# EasyEDA Pro project YanQi_Project_V2.0.eprj, board PayloadBoard (continued)
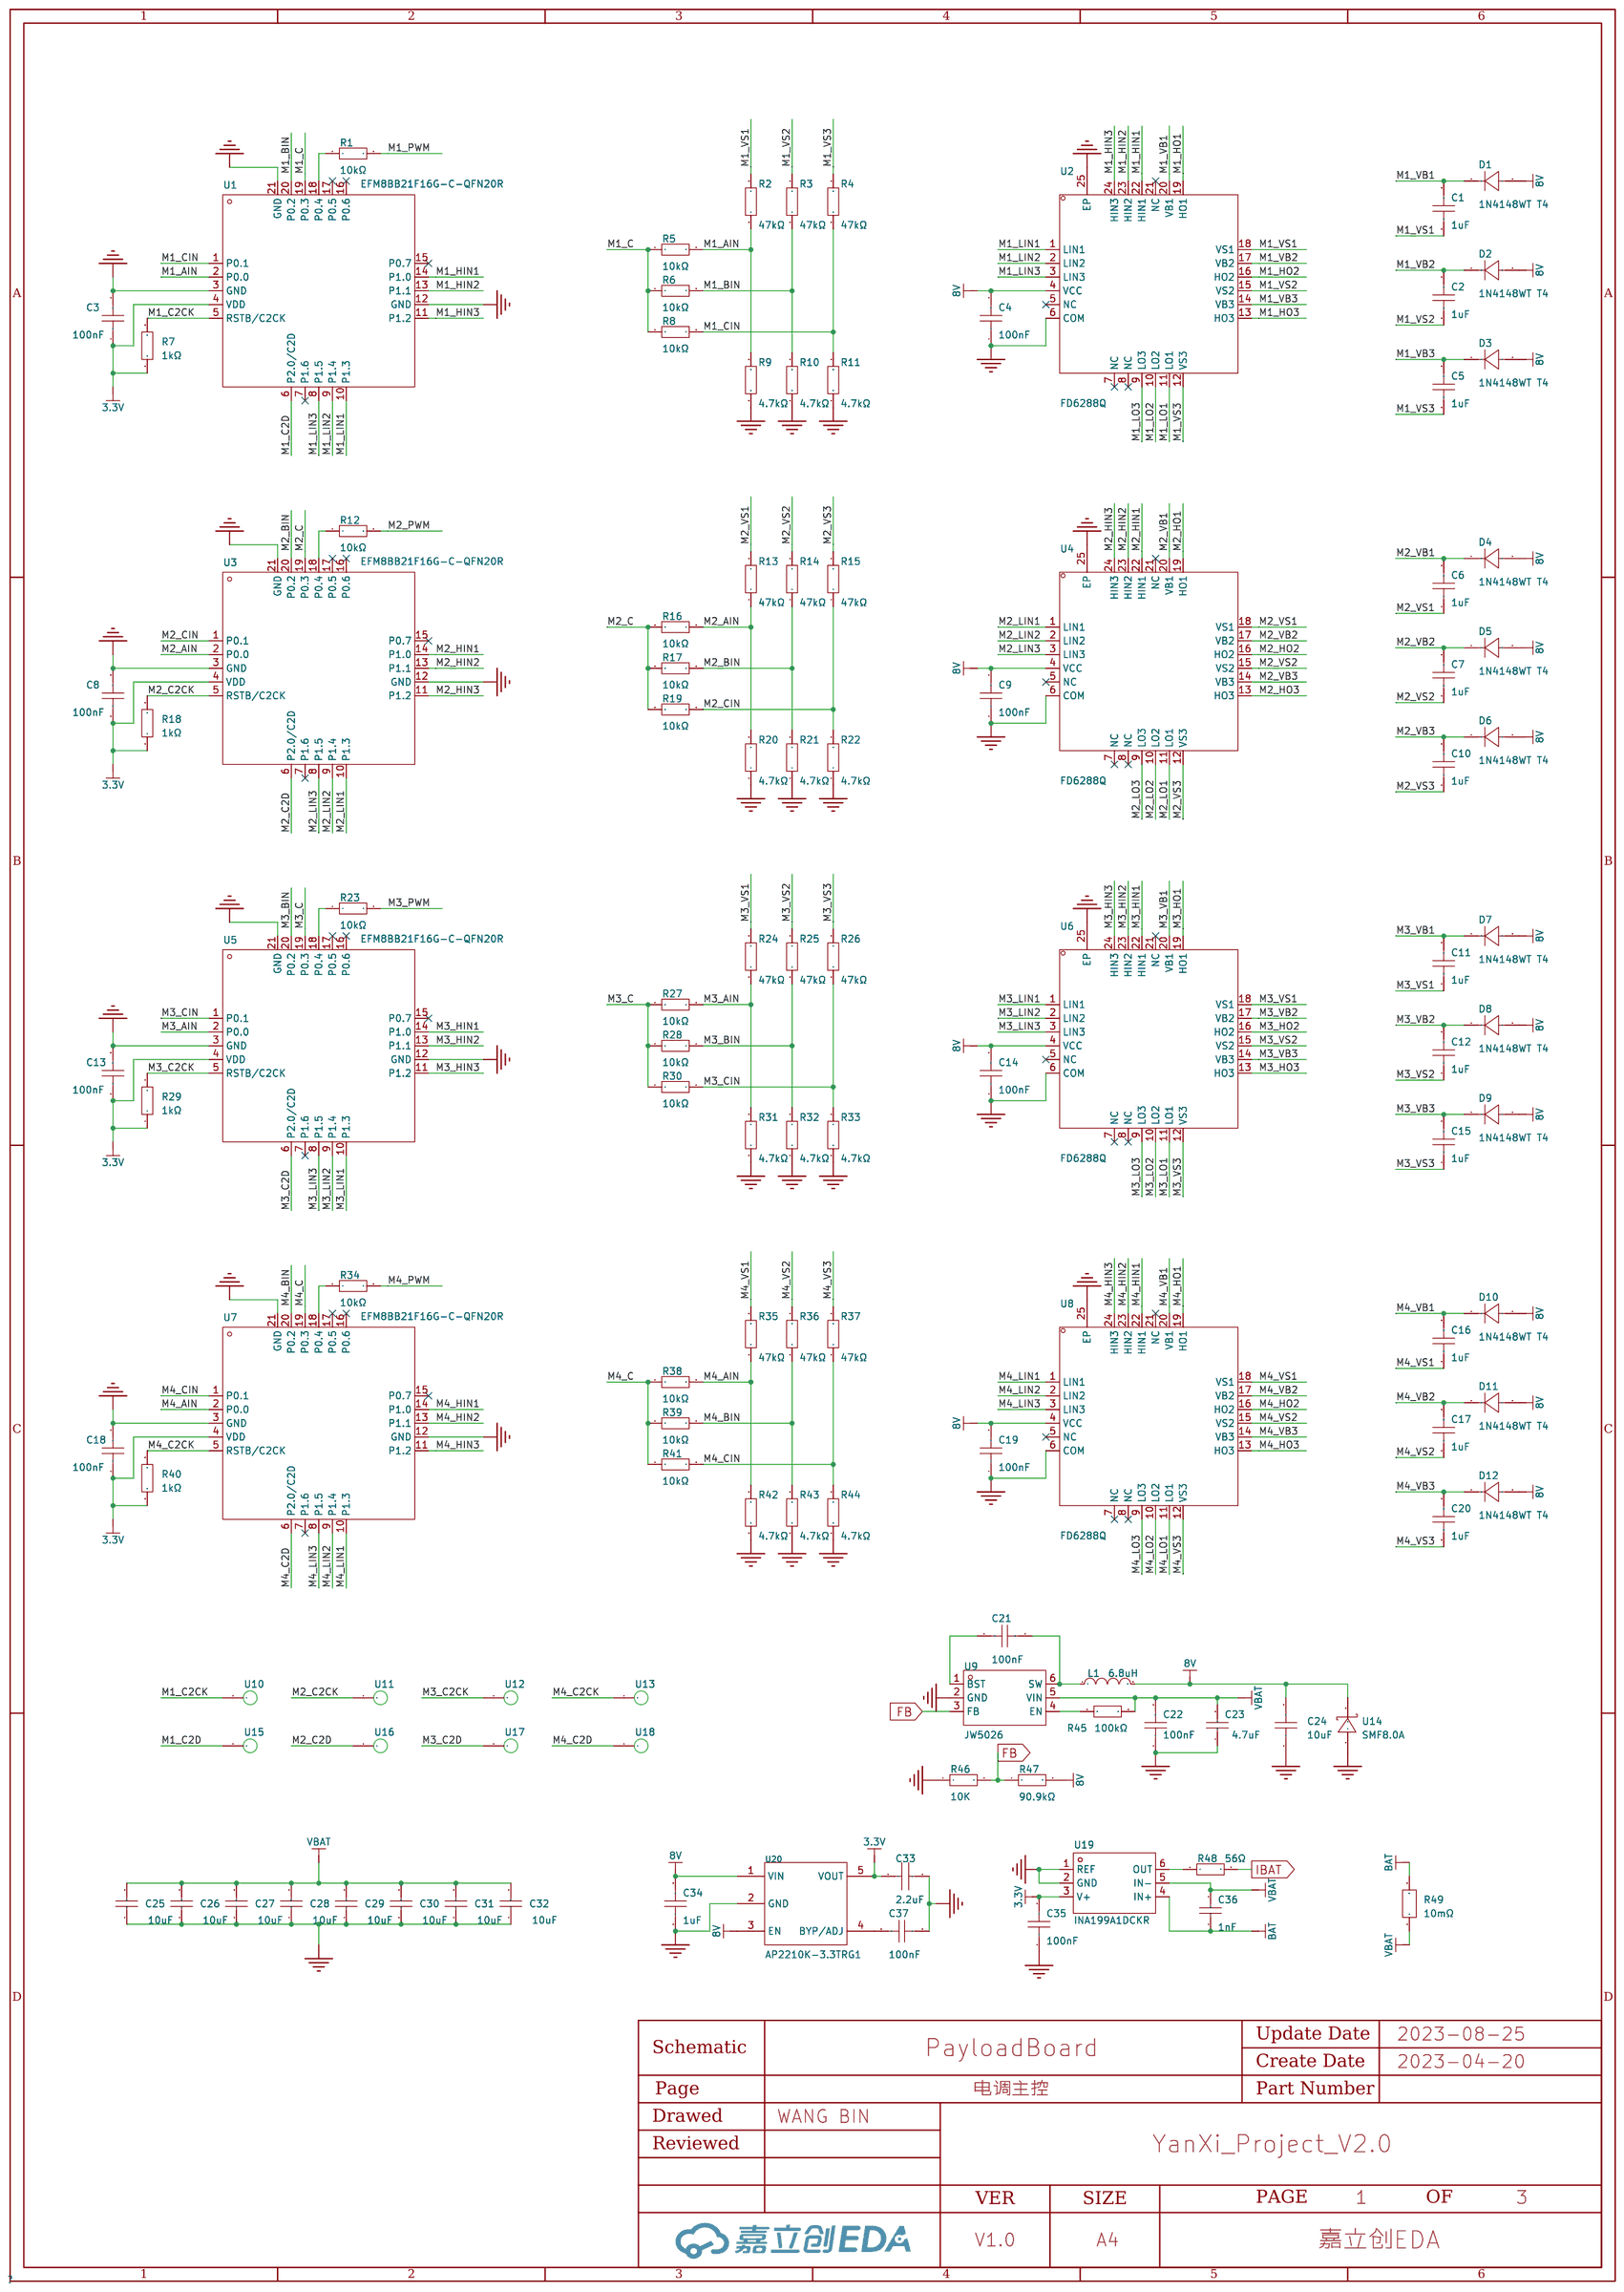
[diagram p0: 电调主控]
## Routing (per net, layer and track width the routed paths; a pad name or vN(x,y) marks a point on that pad's centre or on a via; arc(x,y) is an arc through that point) (continued)
  Inner2 w0.254: 15.25,46.89 15.25,47.7 15.75,48.2 15.75,48.95 15.25,49.45 15.25,52.5 v1(17.4,54.65) ; 15.25,46.89 15.25,42.85 14.05,41.65 14.05,37.9 13.7,37.55 v1(13.5,37.55) ; 15.25,46.89 15.21,46.85 v1(14.7,46.85) ; v1(77.13,83.36) 77.13,83.01 74.57,80.45 72.9,80.45 72.15,79.7 v1(70.7,79.7) 70.6,79.8 v1(68.8,79.8) v1(68.3,79.8) ; v1(70.65,73.4) 71.75,73.4 72.3,72.85 72.3,70.5 71.75,69.95 71.75,41.7 v1(72.15,41.3) 72.6,41.3 73.1,41.8 v1(73.8,41.8)
  Bottom Layer w0.254: v1(74.4,71.35) 72.66,71.35 72.25,71.76 72.25,72.95 71.8,73.4 v1(70.65,73.4) 70.65,73.36 ; v1(11.43,83.35) 11.15,83.35 11,83.2 U6.4 ; v1(76.07,34.65) 76.35,34.65 76.5,34.8 U8.4 ; v1(68.8,79.8) 70.6,79.8 v1(70.7,79.7) ; v1(10.37,34.64) 10.5,34.76 U4.4 ; v1(77.13,83.36) 77,83.24 U2.4
  Bottom Layer w0.6: 67.5,80.76 67.5,80.35 68.05,79.8 v1(68.3,79.8) v1(68.8,79.8) ; 67.5,80.76 67.5,81.2 68,81.7 U20.1 ; 67.5,80.76 65.38,80.76 64.73,81.4 64.73,81.93 65.47,82.67 65.47,83
GND:
  vias: v1(0.5,72.2) v1(0.5,45.8) v1(0.95,72.2) v1(0.95,71.75) v1(0.95,46.25) v1(0.95,45.8) v1(1.05,44.43) v1(1.05,43.78) v1(1.05,43.13) v1(1.4,72.2) v1(1.4,71.75) v1(1.4,46.25) v1(1.4,45.8) v1(1.83,81.96) v1(1.85,71.75) v1(1.85,46.25) v1(1.85,45.8) v1(2.01,35.63) v1(2.28,82.41) v1(2.28,81.96) v1(2.28,78.04) v1(2.28,39.96) v1(2.46,35.63) v1(2.46,35.18) v1(4.05,74.88) v1(4.05,74.23) v1(4.05,73.58) v1(5.25,44.43) v1(5.25,43.78) v1(5.25,43.13) v1(6.02,35.61) v1(6.02,35.16) v1(6.21,82.42) v1(6.21,81.97) v1(6.47,35.61) v1(6.66,81.97) v1(8.25,74.88) v1(8.25,74.23) v1(8.25,73.58) v1(9.45,44.43) v1(9.45,43.78) v1(9.45,43.13) v1(10.5,81.15) v1(10.5,80.7) v1(10.5,80.25) v1(10.5,37.3) v1(10.5,36.85) v1(10.95,81.15) v1(10.95,80.7) v1(10.95,80.25) v1(10.95,37.3) v1(10.95,36.85) v1(11.4,80.7) v1(11.4,80.25) v1(11.4,37.3) v1(11.4,36.85) v1(12.45,74.88) v1(12.45,74.23) v1(12.45,73.58) v1(13.1,76.2) v1(13.1,75.75) v1(15.75,56.5) v1(15.75,55.5) v1(15.9,40.2) v1(15.9,39.75) v1(15.9,39.3) v1(15.9,38.85) v1(15.9,38.4) v1(17.2,61.95) v1(17.2,61.5) v1(17.2,61.05) v1(17.55,64.6) v1(17.55,53.4) v1(32.35,36.1) v1(32.85,36.6) v1(32.85,36.1) v1(32.85,35.6) v1(33.35,37.1) v1(33.35,36.6) v1(33.35,36.1) v1(33.35,35.6) v1(33.35,35.1) v1(33.85,37.6) v1(33.85,37.1) v1(33.85,36.6) v1(33.85,36.1) v1(33.85,35.6) v1(33.85,35.1) v1(33.85,34.6) v1(42.35,89.3) v1(45.15,89.3) v1(54.15,37.1) v1(54.15,36.6) v1(54.15,36.1) v1(54.15,35.6) v1(54.15,35.1) v1(54.65,36.6) v1(54.65,36.1) v1(54.65,35.6) v1(55.15,36.1) v1(61.75,80.75) v1(63.33,81.4) v1(68.29,82.75) v1(73.03,82) v1(74.4,42.25) v1(74.4,41.8) v1(75.05,44.42) v1(75.05,43.78) v1(75.05,43.12) v1(76.1,81.15) v1(76.1,80.7) v1(76.1,37.75) v1(76.1,37.3) v1(76.1,36.85) v1(76.55,81.15) v1(76.55,80.7) v1(76.55,37.75) v1(76.55,37.3) v1(76.55,36.85) v1(77,81.15) v1(77,80.7) v1(77,37.75) v1(77,37.3) v1(77,36.85) v1(78.05,74.88) v1(78.05,74.22) v1(78.05,73.58) v1(79.25,44.42) v1(79.25,43.78) v1(79.25,43.12) v1(81.03,82.39) v1(81.01,35.63) v1(81.48,82.84) v1(81.48,82.39) v1(81.46,35.63) v1(81.46,35.18) v1(82.25,74.88) v1(82.25,74.22) v1(82.25,73.58) v1(83.45,44.42) v1(83.45,43.78) v1(83.45,43.12) v1(85.04,82.79) v1(85.04,82.34) v1(85.04,39.97) v1(85.02,35.61) v1(85.02,35.16) v1(85.21,78.03) v1(85.49,82.34) v1(85.47,35.61) v1(85.65,72.2) v1(85.65,71.75) v1(85.65,46.25) v1(86.1,72.2) v1(86.1,71.75) v1(86.1,46.25) v1(86.1,45.8) v1(86.45,74.88) v1(86.45,74.22) v1(86.45,73.58) v1(86.55,72.2) v1(86.55,71.75) v1(86.55,46.25) v1(86.55,45.8) v1(87,72.2) v1(87,45.8) v2(14.53,36.1) v2(17.95,74.14) v2(18.65,80.75) v2(19.2,80.75) v2(19.75,80.75) v2(20.45,74.15) v2(22.95,74.15) v2(23.35,79.95) v2(23.35,79.45) v2(32.13,71.14) v2(35.36,71.17) v2(35.37,66.83) v2(35.36,51.17) v2(52.13,71.14) v2(52.13,66.83) v2(52.13,51.14) v2(52.13,46.83) v2(55.36,71.17)
VBAT: length 33.7
  Top Layer w0.254: U19.5 23.46,82.35 24.05,82.94 26.17,82.94 R49.1 ; C22.2 61.91,82.89 v1(61.91,82.6)
  Top Layer w0.6: v2(69.3,77.6) 59.14,77.6 v2(59.1,77.64) ; C26.2 61.89,77.64 63,78.75 63,80.15 63.6,80.75 U9.5 ; v2(17.95,77.34) C31.2 v2(22.95,77.34)
  Bottom Layer w0.6: v1(61.91,82.6) 60.65,82.6 59.1,81.05 v2(59.1,77.64) ; v2(61.65,77.65) 61.77,77.77 R45.2
  vias: v1(1.05,74.88) v1(1.05,74.23) v1(1.05,73.58) v1(4.05,44.43) v1(4.05,43.78) v1(4.05,43.13) v1(5.25,74.88) v1(5.25,74.23) v1(5.25,73.58) v1(8.25,44.43) v1(8.25,43.78) v1(8.25,43.13) v1(9.45,74.88) v1(9.45,74.23) v1(9.45,73.58) v1(12.45,44.43) v1(12.45,43.78) v1(12.45,43.13) v1(13.45,75.05) v1(13.45,74.55) v1(13.45,74.05) v1(13.45,73.55) v1(13.45,73.05) v1(13.45,72.55) v1(13.45,72.05) v1(13.45,46) v1(13.45,45.5) v1(13.45,45) v1(13.45,44.5) v1(13.45,44) v1(13.45,43.5) v1(13.95,75.05) v1(13.95,74.55) v1(13.95,74.05) v1(13.95,73.55) v1(13.95,73.05) v1(13.95,72.55) v1(13.95,72.05) v1(13.95,46) v1(13.95,45.5) v1(13.95,45) v1(13.95,44.5) v1(13.95,44) v1(13.95,43.5) v1(13.95,43) v1(14.45,75.05) v1(14.45,74.55) v1(14.45,74.05) v1(14.45,73.55) v1(14.45,73.05) v1(14.45,72.55) v1(14.45,72.05) v1(14.45,46) v1(14.45,45.5) v1(14.45,45) v1(14.45,44.5) v1(14.45,44) v1(14.45,43.5) v1(14.45,43) v1(73.05,75) v1(73.05,74.5) v1(73.05,74) v1(73.05,73.5) v1(73.05,73) v1(73.05,72.5) v1(73.05,72) v1(73.05,45.95) v1(73.05,45.45) v1(73.05,44.95) v1(73.05,44.45) v1(73.05,43.95) v1(73.05,43.45) v1(73.05,42.95) v1(73.55,75) v1(73.55,74.5) v1(73.55,74) v1(73.55,73.5) v1(73.55,73) v1(73.55,72.5) v1(73.55,72) v1(73.55,45.95) v1(73.55,45.45) v1(73.55,44.95) v1(73.55,44.45) v1(73.55,43.95) v1(73.55,43.45) v1(73.55,42.95) v1(74.05,74.5) v1(74.05,74) v1(74.05,73.5) v1(74.05,73) v1(74.05,72.5) v1(74.05,72) v1(74.05,45.95) v1(74.05,45.45) v1(74.05,44.95) v1(74.05,44.45) v1(74.05,43.95) v1(74.05,43.45) v1(74.05,42.95) v1(75.05,74.88) v1(75.05,74.22) v1(75.05,73.58) v1(78.05,44.42) v1(78.05,43.78) v1(78.05,43.12) v1(79.25,74.88) v1(79.25,74.22) v1(79.25,73.58) v1(82.25,44.42) v1(82.25,43.78) v1(82.25,43.12) v1(83.45,74.88) v1(83.45,74.22) v1(83.45,73.58) v1(86.45,44.42) v1(86.45,43.78) v1(86.45,43.12) v2(14.55,54.5) v2(20.45,77.35) v2(25.65,80.94) v2(25.65,80.44) v2(25.65,79.94) v2(25.65,79.44) v2(25.65,78.94) v2(26.15,80.94) v2(26.15,80.44) v2(26.15,79.94) v2(26.15,79.44) v2(26.15,78.94) v2(26.65,80.94) v2(26.65,80.44) v2(26.65,79.94) v2(26.65,79.44) v2(26.65,78.94) v2(27.15,80.94) v2(27.15,80.44) v2(27.15,79.94) v2(27.15,79.44) v2(27.15,78.94) v2(27.65,80.94) v2(27.65,80.44) v2(27.65,79.94) v2(27.65,79.44) v2(27.65,78.94) v2(64.2,77.59) v2(66.75,77.59)
BAT: length 8.2
  Top Layer w0.254: R49.2 25.72,76.38 24.65,77.45 24.65,81.25 C36.1 23.9,81.7 U19.4
BUZ-: length 36.7
  Top Layer w0.254: U25.3 v1(34.25,94) ; v1(18.8,79.35) BUZZER1.2
  Inner2 w0.254: v1(18.8,79.35) 17.2,80.95 14.35,80.95 14,81.3 14,82 15.51,83.51 27.71,83.51 28.91,84.71 28.91,88.56 33.4,93.05 33.42,93.07 34.25,93.9 v1(34.25,94)
FB: length 2.6
  Top Layer w0.254: U9.3 61,79.8 60.47,80.33 60.38,80.33 R46.2
IBAT: length 32
  Top Layer w0.254: v1(16.2,57.15) 15.85,57.5 U27.4 ; R48.2 v1(22.55,78.5)
  Inner1 w0.254: v1(16.65,73.25) 16.41,73.49 16.41,78.16 16.95,78.7 20.05,78.7 20.4,79.05 22,79.05 v1(22.55,78.5)
  Inner2 w0.254: v1(16.65,73.25) 15.15,71.75 15.15,69.6 15.75,69 15.75,59.25 15.65,59.15 15.65,57.7 v1(16.2,57.15)
M1_AIN: length 11.2
  Top Layer w0.254: R5.2 85.3,75.06 R2.1 R9.2 85.3,75.56 85.3,75.95 84.94,76.31 81.73,76.31 80.34,77.7 79.05,77.7 78.49,78.26 78.49,79.71 78.25,79.95 U1.2
M1_BIN: length 14.7
  Top Layer w0.254: v1(74.55,75.9) 74.3,75.9 74.05,76.15 74.05,76.59 75.31,77.85 76.85,77.85 77.3,78.3 U1.20 ; R6.2 80.61,75.05 R3.1 R10.2 81.1,75.56 81.1,75.92 80.68,76.34 77.56,76.34 v1(77,76.9)
  Inner2 w0.254: v1(77,76.9) 76.6,76.9 76.15,76.45 75.4,76.45 74.85,75.9 v1(74.55,75.9)
M1_C: length 26.2
  Top Layer w0.254: R5.1 84.8,75.7 84.55,75.95 84.11,75.95 83.56,75.4 v1(82.7,75.4) ; v1(74.05,77.25) 75,78.2 76.35,78.2 76.8,78.65 U1.19 ; R8.1 76.4,75.82 76.17,76.05 75.7,76.05 v1(75.5,75.85) ; R6.1 80.09,75.54 v1(80.05,75.5) 79.56,75.99 78.89,75.99 78.55,75.65 v1(78.55,75.5)
  Inner1 w0.254: v1(78.55,75.5) 77.95,75.5 77.5,75.05 77.5,73.85 76.3,72.65 75.42,72.65 75.23,72.47 74.87,72.47 74.55,72.79 74.55,74.7 74.05,75.2 v1(74.05,77.25)
  Inner2 w0.254: v1(82.7,75.4) 82.65,75.35 80.2,75.35 v1(80.05,75.5)
  Bottom Layer w0.254: v1(75.5,75.85) 75.5,76.2 74.45,77.25 v1(74.05,77.25)
M1_C2CK: length 4.3
  Top Layer w0.254: U1.5 78.25,81.45 78.6,81.8 78.6,82.5 v1(78.8,82.7)
  Inner1 w0.254: v1(80.25,83.3) 79.65,82.7 v1(79.65,82.09) 79.41,82.09 v1(78.8,82.7)
M1_C2D: length 2.3
  Top Layer w0.254: U15.1 78.5,83.3 77.93,82.73 77.93,81.95
M1_CIN: length 15.7
  Top Layer w0.254: v1(78.5,77.55) 78.5,77.75 78.14,78.11 78.14,79.23 77.93,79.45 ; R8.2 76.41,75.05 R4.1 R11.2 76.91,75.84 76.3,76.45 75.41,76.45 75.05,76.09 75.05,75.65 74.79,75.4 v1(74.55,75.4)
  Inner1 w0.254: v1(74.55,76.4) 74.55,78.45 75.1,79 77.95,79 78.5,78.45 v1(78.5,77.55)
  Inner2 w0.254: v1(74.55,75.4) 74.35,75.4 74.1,75.65 74.1,76.15 74.35,76.4 v1(74.55,76.4)
M1_HIN1: length 2.2
  Top Layer w0.254: U1.14 74.7,80.45 74.2,80.95 v1(74,80.95)
  Bottom Layer w0.254: v1(74,80.95) U2.22
M1_HIN2: length 2.2
  Top Layer w0.254: v1(74,81.45) 74.2,81.45 74.7,80.95 U1.13
  Bottom Layer w0.254: v1(74,81.45) U2.23
M1_HIN3: length 2
  Top Layer w0.254: U1.11 74,81.95
  Bottom Layer w0.254: v1(74,81.95) U2.24
M1_HO1: length 14.9
  Inner1 w0.254: v1(74,79.45) 78.1,79.45 78.91,78.64 80.1,78.64 83.24,75.5 83.6,75.5 83.9,75.2 83.9,73.2 83.62,72.92 v1(83.6,72.92)
  Bottom Layer w0.254: v1(74,79.45) U2.19
M1_HO2: length 8.6
  Inner1 w0.254: v1(79.4,72.92) 79.7,73.23 79.7,75.21 79.55,75.36 79.55,75.9 79,76.45 76.81,76.45 76.5,76.76 76.5,77.4
  Bottom Layer w0.254: U2.16 v1(76.5,77.4)
M1_HO3: length 11.2
  Inner1 w0.254: v1(75.05,72.92) 75.65,73.53 75.65,74.91 75.05,75.52 75.05,78.35 75.35,78.65 77.8,78.65 78,78.45 v1(78,77.55)
  Bottom Layer w0.254: U2.13 v1(78,77.55)
M1_LIN1: length 1.8
  Top Layer w0.254: v1(75.5,83.2) 75.5,83 75.8,82.7 U1.10
  Bottom Layer w0.254: U2.1 v1(75.5,83.2)
M1_LIN2: length 1.8
  Top Layer w0.254: U1.9 76.3,82.75 76,83.05 v1(76,83.2)
  Bottom Layer w0.254: U2.2 v1(76,83.2)
M1_LIN3: length 1.7
  Top Layer w0.254: U1.8 76.8,82.9 v1(76.5,83.2)
  Bottom Layer w0.254: U2.3 76.5,83.12
M1_LO1: length 11.9
  Inner1 w0.254: v1(86.45,72.92) 86.45,72.94 86,73.39 86,74.15 85.34,74.81 85.34,76.01 84.9,76.45 83.29,76.45 79.79,79.95 v1(79.3,79.95)
  Bottom Layer w0.254: U2.11 v1(79.3,79.95)
M1_LO2: length 9.5
  Inner1 w0.254: v1(79.8,78.15) 81.5,76.45 81.5,74.64 81.75,74.38 81.75,73.17 82,72.92 v1(82.1,72.92)
  Bottom Layer w0.254: v1(79.8,78.15) 79.8,80.15 79.5,80.45 U2.10
M1_LO3: length 10.8
  Top Layer w0.254: v1(79.3,80.95) 78.85,80.5 78.85,78.55 79.25,78.15 v1(79.3,78.15)
  Inner2 w0.254: v1(79.3,78.15) 79.3,77.6 76.6,74.9 76.6,73.96 77.63,72.92 v1(77.8,72.92)
  Bottom Layer w0.254: U2.9 v1(79.3,80.95)
M1_PWM: length 146.2
  Top Layer w0.254: U27.10 14.9,63.5 15.55,62.85 17.05,62.85 v1(17.1,62.8) ; R1.2 73.55,77.52 73.55,76.4 72.3,75.15 72.3,70.45 71.76,69.91 71.76,42.64 73.2,41.2 73.2,37.45 72.75,37 72.03,37 70.93,35.9 55.7,35.9 52.55,32.75 52.55,27.15 50.9,25.5 37.65,25.5 34.9,28.25 34.9,32.79 32,35.7 v1(18.75,35.7)
  Inner1 w0.254: v1(18.75,35.7) 18.4,35.7 17.1,37 15.55,37 14.4,38.15 14.4,41.5 15.59,42.69 15.59,48.04 15.75,48.2 15.75,54.55 16.7,55.5 16.7,62.4 v1(17.1,62.8)
M1_VB1: length 16
  Top Layer w0.254: 84.37,74.23 D1.1 ; 84.37,74.23 84.3,74.31 v1(84.3,75.5) ; 84.37,74.23 85.55,73.06
  Inner1 w0.254: v1(74,79.95) 78.1,79.95 79.05,79 80.25,79 83.34,75.9 83.9,75.9 v1(84.3,75.5)
  Bottom Layer w0.254: v1(74,79.95) U2.20
M1_VB2: length 9.4
  Top Layer w0.254: 81.35,73.06 80.17,74.23 D2.1 80.15,74.65 79.3,75.5 v1(79.05,75.5)
  Inner1 w0.254: v1(79.05,75.5) 79.05,75.9 78.86,76.09 76.61,76.09 76,76.7 v1(76,77.4)
  Bottom Layer w0.254: U2.17 v1(76,77.4)
M1_VB3: length 7.4
  Top Layer w0.254: 77.15,73.06 75.97,74.23 D3.1 75.9,74.28 v1(75.9,75.5)
  Inner2 w0.254: v1(77.5,77.55) 77.5,76.3 76.7,75.5 v1(75.9,75.5)
  Bottom Layer w0.254: U2.14 v1(77.5,77.55)
M1_VS1: length 18.3
  Top Layer w0.254: R2.2 85.79,74.39 C1.1
  Inner2 w0.254: v1(75.5,77.4) 75.5,78.5 76,79 80.75,79 82.22,77.52 83.31,77.52 v1(85.79,75.05)
  Bottom Layer w0.254: U2.18 v1(75.5,77.4)
  Bottom Layer w1: D13.1 85.37,76.68 85.37,74
M1_VS2: length 13.9
  Top Layer w0.254: R3.2 81.59,74.39 C2.1
  Inner2 w0.254: v1(77,77.4) 77,78.45 77.19,78.64 80.6,78.64 81.59,77.65 81.59,76.46 v1(82.2,75.85)
  Bottom Layer w0.254: U2.15 v1(77,77.4)
  Bottom Layer w1: 81.17,74 81.17,75.32 D14.1
  vias: v1(81.3,74.15)
M1_VS3: length 16.5
  Top Layer w0.254: R4.2 77.39,74.49 v1(77.05,74.14)
  Inner1 w0.254: v1(75.5,76.9) 75.5,76.65 77.05,75.1 v1(77.05,74.14)
  Inner2 w0.254: v1(75.5,76.9) 75.27,76.9 75.05,77.12 75.05,78.55 75.85,79.35 79.2,79.35 v1(79.3,79.45)
  Bottom Layer w0.254: U2.12 v1(79.3,79.45)
  Bottom Layer w1: 76.97,74 76.97,75.52 78.15,76.7 D15.1
M2_AIN: length 11.2
  Top Layer w0.254: R16.2 2.2,42.94 2.19,42.95 2.19,42.45 2.2,42.44 2.2,42.05 2.56,41.69 5.77,41.69 7.17,40.3 8.45,40.3 9.01,39.75 9.01,38.3 9.25,38.05 U3.2
M2_BIN: length 14.7
  Top Layer w0.254: U3.20 10.2,39.7 10.65,40.15 12.19,40.15 13.45,41.41 13.45,41.85 13.2,42.1 v1(12.95,42.1) ; R17.2 6.89,42.95 6.39,42.95 6.39,42.45 6.4,42.44 6.4,42.08 6.83,41.66 9.94,41.66 v1(10.5,41.1)
  Inner2 w0.254: v1(12.95,42.1) 12.65,42.1 12.1,41.55 11.35,41.55 10.9,41.1 v1(10.5,41.1)
M2_C: length 26.2
  Top Layer w0.254: R19.1 11.1,42.18 11.33,41.95 11.8,41.95 v1(12,42.15) ; v1(4.9,42.5) 3.84,42.5 3.39,42.05 2.95,42.05 2.7,42.3 R16.1 ; v1(8.95,42.5) 8.95,42.35 8.61,42.01 7.94,42.01 v1(7.45,42.5) 7.41,42.46 R17.1 ; v1(13.45,40.75) 12.5,39.8 11.15,39.8 10.7,39.35 U3.19
  Inner1 w0.254: v1(8.95,42.5) 9.55,42.5 10,42.95 10,44.15 11.2,45.35 12.08,45.35 12.27,45.53 12.63,45.53 12.95,45.21 12.95,43.3 13.45,42.8 v1(13.45,40.75)
  Inner2 w0.254: v1(4.9,42.5) 5.05,42.65 7.3,42.65 v1(7.45,42.5)
  Bottom Layer w0.254: v1(13.45,40.75) 13.05,40.75 12,41.8 v1(12,42.15)
M2_C2CK: length 4.3
  Top Layer w0.254: U3.5 9.25,36.55 8.9,36.2 8.9,35.5 v1(8.7,35.3)
  Inner1 w0.254: v1(8.7,35.3) 8.09,35.91 v1(7.85,35.91) 7.85,35.3 v1(7.25,34.7)
M2_C2D: length 2.3
  Top Layer w0.254: U16.1 9,34.7 9.57,35.27 U3.6
M2_CIN: length 15.7
  Top Layer w0.254: 10.59,42.45 10.59,42.16 11.2,41.55 12.09,41.55 12.45,41.91 12.45,42.35 12.71,42.6 v1(12.95,42.6) ; U3.1 9.36,38.77 9.36,39.89 9,40.25 v1(9,40.45) ; R19.2 11.09,42.95 10.59,42.95 R22.2
  Inner1 w0.254: v1(12.95,41.6) 12.95,39.55 12.4,39 9.55,39 9,39.55 v1(9,40.45)
  Inner2 w0.254: v1(12.95,42.6) 13.15,42.6 13.4,42.35 13.4,41.85 13.15,41.6 v1(12.95,41.6)
M2_HIN1: length 2.2
  Top Layer w0.254: U3.14 12.8,37.55 13.3,37.05 v1(13.5,37.05)
  Bottom Layer w0.254: U4.22 v1(13.5,37.05)
M2_HIN2: length 2.1
  Top Layer w0.254: v1(13.5,36.55) 13.3,36.55 12.8,37.05 U3.13
  Bottom Layer w0.254: U4.23 v1(13.5,36.55)
M2_HIN3: length 2
  Top Layer w0.254: U3.11 13.5,36.05
  Bottom Layer w0.254: U4.24 v1(13.5,36.05)
M2_HO1: length 14.9
  Inner1 w0.254: v1(3.9,45.08) 3.88,45.08 3.6,44.8 3.6,42.8 3.9,42.5 4.26,42.5 7.4,39.36 8.59,39.36 9.4,38.55 v1(13.5,38.55)
  Bottom Layer w0.254: v1(13.5,38.55) U4.19
M2_HO2: length 8.6
  Inner1 w0.254: 11,40.6 11,41.24 10.69,41.55 8.5,41.55 7.95,42.1 7.95,42.64 7.8,42.79 7.8,44.77 v1(8.1,45.08)
  Bottom Layer w0.254: U4.16 v1(11,40.6)
M2_HO3: length 11.2
  Inner1 w0.254: v1(12.45,45.08) 11.85,44.48 11.85,43.09 12.45,42.48 12.45,39.65 12.15,39.35 9.7,39.35 9.5,39.55 v1(9.5,40.45)
  Bottom Layer w0.254: U4.13 v1(9.5,40.45)
M2_LIN1: length 1.8
  Top Layer w0.254: U3.10 11.7,35.3 12,35 v1(12,34.8)
  Bottom Layer w0.254: U4.1 v1(12,34.8)
M2_LIN2: length 1.8
  Top Layer w0.254: v1(11.5,34.8) 11.5,34.95 11.2,35.25 U3.9
  Bottom Layer w0.254: U4.2 v1(11.5,34.8)
M2_LIN3: length 1.7
  Top Layer w0.254: v1(11,34.8) 10.7,35.1 U3.8
  Bottom Layer w0.254: U4.3 11,34.88
M2_LO1: length 11.9
  Inner1 w0.254: v1(8.2,38.05) 7.71,38.05 4.21,41.55 2.6,41.55 2.17,41.99 2.17,43.19 1.5,43.85 1.5,44.61 1.05,45.06 v1(1.05,45.08)
  Bottom Layer w0.254: U4.11 v1(8.2,38.05)
M2_LO2: length 9.5
  Inner1 w0.254: v1(5.4,45.08) 5.43,45.08 5.75,44.76 5.75,43.62 6,43.36 6,41.55 v1(7.7,39.85)
  Bottom Layer w0.254: v1(7.7,39.85) 7.7,37.85 8,37.55 U4.10
M2_LO3: length 10.9
  Top Layer w0.254: v1(8.2,39.85) 8.25,39.85 8.65,39.45 8.65,37.5 v1(8.2,37.05)
  Inner2 w0.254: v1(8.2,39.85) 8.2,40.4 10.9,43.1 10.9,44.04 9.87,45.08 v1(9.6,45.08)
  Bottom Layer w0.254: U4.9 v1(8.2,37.05)
M2_PWM: length 27.6
  Top Layer w0.254: U27.9 15.89,62.5 16.7,61.69 16.7,55.5 13.36,52.16 13.36,48.83 15.25,46.94 15.25,42.85 14.05,41.65 14.05,40.58 R12.2
M2_VB1: length 16
  Top Layer w0.254: v1(3.2,42.5) 3.2,43.7 3.13,43.77 ; 3.13,43.77 3.15,43.77 ; 3.13,43.77 C6.2
  Inner1 w0.254: v1(13.5,38.05) 9.4,38.05 8.45,39 7.25,39 4.16,42.1 3.6,42.1 v1(3.2,42.5)
  Bottom Layer w0.254: v1(13.5,38.05) U4.20
M2_VB2: length 9.4
  Top Layer w0.254: C7.2 7.33,43.77 7.35,43.77 7.35,43.35 8.2,42.5 v1(8.45,42.5)
  Inner1 w0.254: v1(8.45,42.5) 8.45,42.1 8.64,41.91 10.89,41.91 11.5,41.3 v1(11.5,40.6)
  Bottom Layer w0.254: U4.17 v1(11.5,40.6)
M2_VB3: length 7.4
  Top Layer w0.254: v1(11.6,42.5) 11.6,43.72 11.55,43.77 11.53,43.77 C10.2
  Inner2 w0.254: v1(11.6,42.5) 10.8,42.5 10,41.7 v1(10,40.45)
  Bottom Layer w0.254: U4.14 v1(10,40.45)
M2_VS1: length 18.3
  Top Layer w0.254: C6.1 1.71,43.61 1.71,42.95
  Inner2 w0.254: v1(1.71,42.95) 4.19,40.48 5.28,40.48 6.75,39 11.5,39 12,39.5 v1(12,40.6)
  Bottom Layer w0.254: U4.18 v1(12,40.6)
  Bottom Layer w1: 2.13,44 2.13,41.32
M2_VS2: length 13.9
  Top Layer w0.254: C7.1 5.91,43.61 5.91,42.95
  Inner2 w0.254: v1(10.5,40.6) 10.5,39.55 10.31,39.36 6.9,39.36 5.91,40.35 5.91,41.54 v1(5.3,42.15)
  Bottom Layer w0.254: U4.15 v1(10.5,40.6)
  Bottom Layer w1: D20.1 6.33,42.68 6.33,44
  vias: v1(6.2,43.85)
M2_VS3: length 16.5
  Top Layer w0.254: 10.11,42.95 10.11,43.51 v1(10.45,43.86)
  Inner1 w0.254: v1(12,41.1) 12,41.35 10.45,42.9 v1(10.45,43.86)
  Inner2 w0.254: v1(12,41.1) 12.23,41.1 12.45,40.88 12.45,39.45 11.65,38.65 8.3,38.65 v1(8.2,38.55)
  Bottom Layer w0.254: U4.12 v1(8.2,38.55)
  Bottom Layer w1: D21.1 9.35,41.3 10.53,42.48 10.53,44
M3_AIN: length 18.8
  Top Layer w0.254: v1(1.15,76.75) 2,76.75 2.91,75.84 R31.2 R24.1 2.9,75.06 2.4,75.06 ; U5.2 13.3,79.95 v1(13.5,80.15)
  Inner1 w0.254: v1(13.5,80.15) 11.8,78.45 8.65,78.45 8.4,78.2 8.4,77.5 8.05,77.15 1.55,77.15 v1(1.15,76.75)
M3_BIN: length 9.8
  Top Layer w0.254: 6.6,75.06 7.1,75.06 R25.1 R32.2 7.1,75.56 7.1,76.15 7.35,76.4 11.65,76.4 12.45,77.2 12.45,77.6 11.7,78.35 U5.20
M3_C: length 27.5
  Top Layer w0.254: R30.1 10.29,76.05 9.3,76.05 8.9,75.65 v1(8.9,75.6) ; R27.1 2.4,75.82 2.07,76.15 v1(1.15,76.15) ; v1(4,76.25) 4.15,76.1 6.35,76.1 6.6,75.85 R28.1 ; v1(8.9,78) 9,78.1 10.6,78.1 11.2,78.7 U5.19
  Inner1 w0.254: v1(8.9,75.6) 7.9,75.6 7.75,75.45 7.75,73.7 6.4,72.35 3.25,72.35 2.9,72.7 2.9,76.15 ; v1(4,76.25) 1.25,76.25 v1(1.15,76.15)
  Inner2 w0.254: v1(8.9,75.6) v1(8.9,78)
M3_C2CK: length 3.2
  Top Layer w0.254: U12.1 12.95,82.9 12.95,82.29 R29.2 13.16,81.74 12.87,81.45 U5.5
M3_C2D: length 1.4
  Top Layer w0.254: U5.6 12.33,83.28 U17.1
M3_CIN: length 7.5
  Top Layer w0.254: U5.1 12.33,78.22 12.65,77.9 v1(13.5,77.9) ; v1(12.45,76) 11.47,76 11.31,75.84 R33.2 R26.1 11.3,75.06 10.8,75.06
  Inner1 w0.254: v1(13.5,77.9) 13.3,77.9 12.81,77.41 12.81,76.91 12.45,76.55 v1(12.45,76)
M3_HIN1: length 2.2
  Top Layer w0.254: U5.14 8.7,80.45 v1(8.2,80.95)
  Bottom Layer w0.254: U6.22 v1(8.2,80.95)
M3_HIN2: length 2.2
  Top Layer w0.254: U5.13 9,80.95 8.5,81.45 v1(8.2,81.45)
  Bottom Layer w0.254: U6.23 v1(8.2,81.45)
M3_HIN3: length 2
  Top Layer w0.254: U5.11 8.2,81.95
  Bottom Layer w0.254: U6.24 v1(8.2,81.95)
M3_HO1: length 13.9
  Inner1 w0.254: v1(8.2,79.45) 7.21,79.45 5.28,77.52 1.05,77.52 0.7,77.17 0.7,75.87 1.5,75.06 1.5,73.38 v1(1.05,72.93)
  Bottom Layer w0.254: v1(8.2,79.45) U6.19
M3_HO2: length 9.5
  Inner1 w0.254: v1(5.25,72.93) 5.7,73.38 5.7,74.75 7.36,76.41 9.84,76.41 10.5,77.07 v1(10.5,77.4)
  Bottom Layer w0.254: U6.16 v1(10.5,77.4)
M3_HO3: length 7.1
  Inner1 w0.254: v1(12,77.4) 12,77.1 11.75,76.85 11.35,76.85 9.9,75.4 9.9,73.23 v1(9.6,72.93)
  Bottom Layer w0.254: U6.13 v1(12,77.4)
M3_LIN1: length 2
  Top Layer w0.254: U5.10 9.5,82.85 v1(9.5,83.25)
  Bottom Layer w0.254: v1(9.5,83.25) U6.1
M3_LIN2: length 2.2
  Top Layer w0.254: v1(10,83.25) 10,83.1 10.32,82.78 10.57,82.78 10.7,82.65 U5.9
  Bottom Layer w0.254: v1(10,83.25) U6.2
M3_LIN3: length 2.2
  Top Layer w0.254: U5.8 11.2,82.91 10.86,83.25 v1(10.5,83.25)
  Bottom Layer w0.254: v1(10.5,83.25) U6.3
M3_LO1: length 17.3
  Inner2 w0.254: v1(13.5,78.9) 7.16,78.9 5.43,77.17 3.42,77.17 2.94,76.69 2.94,74.04 v1(4.05,72.93)
  Bottom Layer w0.254: U6.11 13.02,79.95 13.5,79.47 v1(13.5,78.9)
M3_LO2: length 13.2
  Inner1 w0.254: v1(7.81,77.65) 7.81,78.11 8.6,78.9 11.75,78.9 13.05,80.2 13.05,80.45 13.3,80.7 v1(13.5,80.7)
  Inner2 w0.254: v1(8.1,72.93) 7.8,73.23 7.8,77.63 v1(7.81,77.65)
  Bottom Layer w0.254: v1(13.5,80.7) 13.37,80.7 13.12,80.45 U6.10
M3_LO3: length 11.2
  Inner2 w0.254: v1(12.45,72.93) 12,73.38 12,76.76 12.64,77.4 v1(13.5,77.4)
  Bottom Layer w0.254: v1(13.5,77.4) 13.75,77.4 13.95,77.6 13.95,80.95 13.7,81.2 13.27,81.2 13.02,80.95 U6.9
M3_PWM: length 40.5
  Top Layer w0.254: U27.8 v1(16.25,61.5) ; v1(7.3,77.65) 7.3,77.35 7.5,77.15 8.2,77.15 8.4,77.35 R23.2
  Inner1 w0.254: v1(16.25,61.5) 16.25,62.1 15.8,62.55 15.8,70.66 16.05,70.92 16.05,78.35 v1(16.95,79.25)
  Inner2 w0.254: v1(16.95,79.25) 16.65,79.55 9.05,79.55 8.7,79.9 8.7,82.75 v1(8.2,83.25)
  Bottom Layer w0.254: v1(8.2,83.25) 7.3,82.35 v1(7.3,77.65)
M3_VB1: length 12.1
  Top Layer w0.254: 3.15,73.06 3.13,73.06 ; 3.14,73.07 1.9,74.31 v1(1.9,75.5)
  Inner2 w0.254: v1(8.2,79.95) 7.71,79.95 5.28,77.52 3.27,77.52 1.9,76.15 v1(1.9,75.5)
  Bottom Layer w0.254: v1(8.2,79.95) U6.20
M3_VB2: length 12.6
  Top Layer w0.254: 7.35,73.06 7.33,73.06 D8.1 6.15,75.3 5.9,75.55 v1(5.25,75.55)
  Inner2 w0.254: v1(10,77.4) 10,78.2 9.75,78.45 7.21,78.45 5.25,76.49 v1(5.25,75.55)
  Bottom Layer w0.254: U6.17 v1(10,77.4)
M3_VB3: length 8.1
  Top Layer w0.254: v1(9.45,75.55) 10.1,75.55 10.35,75.3 D9.1 10.37,74.24 11.55,73.06
  Inner2 w0.254: v1(9.45,75.55) 10.75,76.85 11.25,76.85 11.5,77.1 v1(11.5,77.4)
  Bottom Layer w0.254: U6.14 v1(11.5,77.4)
M3_VS1: length 12.6
  Top Layer w0.254: v1(3.39,75.05) 3.39,74.39 3.15,74.15
  Inner1 w0.254: v1(3.39,75.05) 3.69,75.35 4.24,75.35 5.65,76.76 8.86,76.76 v1(9.5,77.4)
  Bottom Layer w0.254: U6.18 v1(9.5,77.4)
  Bottom Layer w1: Q4.10 2.97,75.88 D16.1
M3_VS2: length 8.7
  Top Layer w0.254: R25.2 7.59,74.39 7.35,74.15
  Inner1 w0.254: v1(11,77.4) 11,77.04 10.01,76.05 7.5,76.05 7.25,75.8 v1(7.25,74.15)
  Bottom Layer w0.254: U6.15 v1(11,77.4)
M3_VS3: length 14.1
  Top Layer w0.254: 11.55,74.15 11.79,74.39 R26.2
  Inner1 w0.254: v1(11.45,74.15) 11.45,76.4 11.55,76.5 11.89,76.5 12.45,77.06 12.45,77.55 13.3,78.4 v1(13.5,78.4)
  Bottom Layer w0.254: U6.12 12.66,78.88 13.14,78.4 v1(13.5,78.4)
  Bottom Layer w1: D18.1 7.87,76.58 10.9,76.58 11.35,76.13 11.35,73.92 Q6.10
M4_AIN: length 18.8
  Top Layer w0.254: R38.2 84.6,42.94 R35.1 R42.2 84.59,42.16 85.5,41.25 v1(86.35,41.25) ; v1(74,37.85) 74.2,38.05 U7.2
  Inner1 w0.254: v1(86.35,41.25) 85.95,40.85 79.45,40.85 79.1,40.5 79.1,39.8 78.85,39.55 75.7,39.55 v1(74,37.85)
M4_BIN: length 9.8
  Top Layer w0.254: U7.20 75.8,39.65 75.05,40.4 75.05,40.8 75.85,41.6 80.15,41.6 80.4,41.85 80.4,42.44 R43.2 R36.1 80.4,42.94 R39.2
M4_C: length 27.5
  Top Layer w0.254: R38.1 85.1,42.18 85.43,41.85 v1(86.35,41.85) ; R41.1 77.21,41.95 78.2,41.95 78.6,42.35 v1(78.6,42.4) ; R39.1 80.9,42.15 81.15,41.9 83.35,41.9 v1(83.5,41.75) ; v1(78.6,40) 78.5,39.9 76.9,39.9 76.3,39.3 U7.19
  Inner1 w0.254: v1(83.5,41.75) 86.25,41.75 v1(86.35,41.85) ; v1(78.6,42.4) 79.6,42.4 79.75,42.55 79.75,44.3 81.1,45.65 84.25,45.65 84.6,45.3 84.6,41.85
  Inner2 w0.254: v1(78.6,42.4) v1(78.6,40)
M4_C2CK: length 3.2
  Top Layer w0.254: U13.1 74.55,35.1 74.55,35.71 R40.2 74.34,36.26 74.63,36.55 U7.5
M4_C2D: length 1.4
  Top Layer w0.254: U7.6 75.17,34.72 U18.1
M4_CIN: length 7.5
  Top Layer w0.254: U7.1 75.17,39.78 74.85,40.1 v1(74,40.1) ; R41.2 76.2,42.94 R37.1 R44.2 76.19,42.16 76.03,42 v1(75.05,42)
  Inner1 w0.254: v1(75.05,42) 75.05,41.45 74.69,41.09 74.69,40.59 74.2,40.1 v1(74,40.1)
M4_HIN1: length 2.2
  Top Layer w0.254: v1(79.3,37.05) 78.8,37.55 U7.14
  Bottom Layer w0.254: U8.22 v1(79.3,37.05)
M4_HIN2: length 2.2
  Top Layer w0.254: v1(79.3,36.55) 79,36.55 78.5,37.05 U7.13
  Bottom Layer w0.254: U8.23 v1(79.3,36.55)
M4_HIN3: length 2
  Top Layer w0.254: 77.93,36.05 79.3,36.05
  Bottom Layer w0.254: U8.24 v1(79.3,36.05)
M4_HO1: length 13.9
  Inner1 w0.254: v1(79.3,38.55) 80.29,38.55 82.22,40.48 86.45,40.48 86.8,40.83 86.8,42.13 86,42.94 86,44.62 v1(86.45,45.08)
  Bottom Layer w0.254: v1(79.3,38.55) U8.19
M4_HO2: length 9.5
  Inner1 w0.254: v1(82.25,45.08) 81.8,44.62 81.8,43.25 80.14,41.59 77.66,41.59 77,40.93 v1(77,40.6)
  Bottom Layer w0.254: U8.16 v1(77,40.6)
M4_HO3: length 7.1
  Inner1 w0.254: v1(77.9,45.08) 77.6,44.77 77.6,42.6 76.15,41.15 75.75,41.15 75.5,40.9 v1(75.5,40.6)
  Bottom Layer w0.254: U8.13 v1(75.5,40.6)
M4_LIN1: length 2
  Top Layer w0.254: U7.10 78,35.15 v1(78,34.75)
  Bottom Layer w0.254: v1(78,34.75) U8.1
M4_LIN2: length 2.2
  Top Layer w0.254: U7.9 76.8,35.35 76.93,35.22 77.18,35.22 77.5,34.9 v1(77.5,34.75)
  Bottom Layer w0.254: v1(77.5,34.75) U8.2
M4_LIN3: length 2.2
  Top Layer w0.254: v1(77,34.75) 76.64,34.75 76.3,35.09 U7.8
  Bottom Layer w0.254: v1(77,34.75) U8.3
M4_LO1: length 17.3
  Inner2 w0.254: v1(83.45,45.08) 84.56,43.96 84.56,41.31 84.08,40.83 82.07,40.83 80.34,39.1 v1(74,39.1)
  Bottom Layer w0.254: v1(74,39.1) 74,38.53 74.48,38.05 U8.11
M4_LO2: length 13.2
  Inner1 w0.254: v1(79.69,40.35) 79.69,39.89 78.9,39.1 75.75,39.1 74.45,37.8 74.45,37.55 74.2,37.3 v1(74,37.3)
  Inner2 w0.254: v1(79.4,45.08) 79.7,44.77 79.7,40.37 v1(79.69,40.35)
  Bottom Layer w0.254: U8.10 74.38,37.55 74.13,37.3 v1(74,37.3)
M4_LO3: length 11.2
  Inner2 w0.254: v1(74,40.6) 74.86,40.6 75.5,41.24 75.5,44.62 v1(75.05,45.08)
  Bottom Layer w0.254: v1(74,40.6) 73.75,40.6 73.55,40.4 73.55,37.05 73.8,36.8 74.23,36.8 74.48,37.05 U8.9
M4_PWM: length 118
  Top Layer w0.254: R34.2 79.1,40.65 79.3,40.85 80,40.85 80.2,40.65 v1(80.2,40.35) ; v1(69.85,35.45) 55.75,35.45 52.9,32.6 52.9,27 51.05,25.15 37.5,25.15 34.55,28.1 34.55,32.65 31.95,35.25 18.49,35.25 18,35.74 18,36.1 17.1,37 14.35,37 14.05,37.3 14.05,40.08 14.4,40.43 14.4,41.5 15.55,42.65 15.55,42.66 15.6,42.7 15.6,47.09 13.72,48.97 13.72,52.02 17.06,55.35 17.06,59.91 v1(17.2,60.05) ; U27.7 15.8,60.5 v1(16.25,60.05)
  Inner1 w0.254: v1(69.85,35.45) 70.35,34.95 75.73,34.95 75.99,35.2 78.85,35.2 v1(79.3,34.75)
  Bottom Layer w0.254: v1(79.3,34.75) 80.2,35.65 v1(80.2,40.35) ; v1(17.2,60.05) v1(16.25,60.05)
M4_VB1: length 12.1
  Top Layer w0.254: 85.53,43.77 85.6,43.69 v1(85.6,42.5) ; 84.35,44.94 84.37,44.94 D10.1
  Inner2 w0.254: v1(79.3,38.05) 79.79,38.05 82.22,40.48 84.23,40.48 85.6,41.85 v1(85.6,42.5)
  Bottom Layer w0.254: v1(79.3,38.05) U8.20
M4_VB2: length 12.6
  Top Layer w0.254: v1(82.25,42.45) 81.6,42.45 81.35,42.7 D11.1 80.17,44.94 80.15,44.94
  Inner2 w0.254: v1(82.25,42.45) 82.25,41.51 80.29,39.55 77.75,39.55 77.5,39.8 v1(77.5,40.6)
  Bottom Layer w0.254: U8.17 v1(77.5,40.6)
M4_VB3: length 8.1
  Top Layer w0.254: v1(78.05,42.45) 77.4,42.45 77.15,42.7 D12.1 77.13,43.77 75.95,44.94
  Inner2 w0.254: v1(78.05,42.45) 76.75,41.15 76.25,41.15 76,40.9 v1(76,40.6)
  Bottom Layer w0.254: U8.14 v1(76,40.6)
M4_VS1: length 12.9
  Top Layer w0.254: C16.1 84.11,43.61 v1(84.11,42.95)
  Inner1 w0.254: v1(84.11,42.95) 83.81,42.65 83,42.65 82.75,42.4 82.75,41.95 82.04,41.24 78.64,41.24 v1(78,40.6)
  Bottom Layer w0.254: U8.18 v1(78,40.6)
  Bottom Layer w1: Q10.10 84.53,42.4 85.35,41.58 D22.1
M4_VS2: length 8.7
  Top Layer w0.254: R36.2 79.91,43.61 C17.1
  Inner1 w0.254: v1(80.25,43.86) 80.25,42.2 80,41.95 77.49,41.95 76.5,40.96 v1(76.5,40.6)
  Bottom Layer w0.254: U8.15 v1(76.5,40.6)
M4_VS3: length 14.1
  Top Layer w0.254: R37.2 75.71,43.61 C20.1
  Inner1 w0.254: v1(76.05,43.86) 76.05,41.6 75.95,41.5 75.61,41.5 75.05,40.94 75.05,40.45 74.2,39.6 v1(74,39.6)
  Bottom Layer w0.254: U8.12 74.84,39.12 74.36,39.6 v1(74,39.6)
  Bottom Layer w1: D24.1 79.63,41.42 76.6,41.42 76.15,41.87 76.15,44.08 Q12.10
RGB: length 75.2
  Top Layer w0.254: U25.5 v1(36.25,94)
  Inner2 w0.254: v1(70.47,82) 70.47,82.62 69.53,83.57 59.98,83.57 58.6,84.95 58.6,92.05 55.65,95 36.95,95 36.25,94.3 v1(36.25,94) 35.05,92.8 33.65,92.8 29.27,88.42 29.27,84.57 27.86,83.16 16.02,83.16 v1(14.48,81.62)
RX1: length 80.8
  Inner1 w0.254: v1(54.25,91.4) 54.95,91.4 58.24,88.12 58.24,75.73 56.85,74.34 56.85,67.65 54.91,65.71 54.91,52.34 56.85,50.4 56.85,47.55 53.26,43.95 53.26,27.96 50.45,25.15 46.35,25.15 H2.3
  Bottom Layer w0.254: v1(54.25,91.4) U35.2
RX3: length 86.3
  Inner1 w0.254: v1(40.25,91.4) 39.25,92.4 35.1,92.4 34.16,91.46 32.81,91.46 28.91,87.56 28.91,75.14 30.19,73.86 30.19,67.54 32.19,65.54 32.19,52.39 30.19,50.39 30.19,47.56 34.55,43.21 34.55,28.1 39.94,22.71 H3.2
  Bottom Layer w0.254: v1(40.25,91.4) U34.2
RX5: length 60.2
  Inner1 w0.254: v1(36.25,91.4) 35.25,90.4 33.25,90.4 29.97,87.12 29.97,75.58 31.25,74.3 31.25,67.98 33.25,65.98 33.25,51.95 31.25,49.95 31.25,48 32.75,46.5 34.76,46.5 35.31,47.05 H1.4
  Bottom Layer w0.254: U34.6 v1(36.25,91.4)
RX7: length 29.4
  Inner2 w0.254: v1(38.25,91.4) 37.75,91.9 37.11,91.9 36.8,91.59 36.8,91.15 36.05,90.4 31.75,90.4 29.62,88.27 29.62,84.42 28,82.8 22.85,82.8 22.2,82.15 22.2,80.05 v1(20.65,78.5)
  Bottom Layer w0.254: v1(38.25,91.4) U34.4 ; v1(20.65,78.5) 20.65,78.5 CN1.2
SCL2: length 91.8
  Top Layer w0.254: U25.10 v1(41.25,94)
  Inner1 w0.254: H2.2 46.75,26.35 47.55,25.55 50.2,25.55 52.9,28.25 52.9,44.1 56.5,47.69 56.5,50.25 54.55,52.2 54.55,65.85 56.5,67.8 56.5,74.49 57.88,75.87 57.88,87.97 56.4,89.45 47.65,89.45 43.1,94 v1(41.25,94)
SDA2: length 88.7
  Top Layer w0.254: U25.9 v1(40.25,94)
  Inner1 w0.254: H2.1 50.85,26.75 52.55,28.45 52.55,44.25 56.14,47.84 56.14,50.11 54.2,52.05 54.2,66 56.14,67.94 56.14,74.64 57.53,76.02 57.53,87.82 56.25,89.1 47.5,89.1 43.2,93.4 41.21,93.4 40.61,94 v1(40.25,94)
TX1: length 85.6
  Inner1 w0.254: v1(53.25,91.4) 53.3,91.4 53.9,92 54.85,92 58.59,88.26 58.59,75.58 57.2,74.2 57.2,67.5 55.26,65.56 55.26,52.49 57.2,50.55 57.2,47.4 53.61,43.81 53.61,27.71 50.65,24.75 44.75,24.75 H2.4
  Bottom Layer w0.254: v1(53.25,91.4) U35.3
TX3: length 86.6
  Inner1 w0.254: H3.3 41.18,23.8 39.35,23.8 34.9,28.25 34.9,43.35 30.54,47.71 30.54,50.24 32.54,52.24 32.54,65.69 30.54,67.69 30.54,74.01 29.27,75.28 29.27,87.42 32.96,91.11 34.31,91.11 35.25,92.05 38.6,92.05 v1(39.25,91.4)
  Bottom Layer w0.254: v1(39.25,91.4) U34.3
TX5: length 63.6
  Inner1 w0.254: v1(35.25,91.4) 34.6,90.75 33.1,90.75 29.62,87.27 29.62,75.43 30.9,74.15 30.9,67.84 32.9,65.84 32.9,52.1 30.9,50.1 30.9,47.86 32.61,46.15 34.91,46.15 35.46,46.7 38.15,46.7 39,45.85 41.28,45.85 H1.3
  Bottom Layer w0.254: v1(35.25,91.4) U34.7
TX7: length 27.2
  Inner2 w0.254: v1(21.65,78.5) 21.65,79 22.55,79.9 22.55,82 23,82.45 28.15,82.45 29.97,84.27 29.97,88.12 31.9,90.05 36.3,90.05 37.25,91 v1(37.25,91.4)
  Bottom Layer w0.254: v1(37.25,91.4) U34.5 ; v1(21.65,78.5) 21.65,79.45 CN1.3
$1N9645: length 2.8
  Top Layer w0.254: U1.18 76.3,78.7 76.2,78.6 74.15,78.6 R1.1
$1N9747: length 2.8
  Top Layer w0.254: R12.1 13.35,39.4 11.3,39.4 11.2,39.3 U3.18
$1N9849: length 3
  Top Layer w0.254: R23.1 8.69,78.5 10.43,78.5 10.7,78.77 U5.18
$1N9951: length 3
  Top Layer w0.254: R34.1 78.81,39.5 77.07,39.5 76.8,39.23 U7.18
